# EAGLE board Dragino Pan.v2.0.1 (EAGLE 7.5.0)
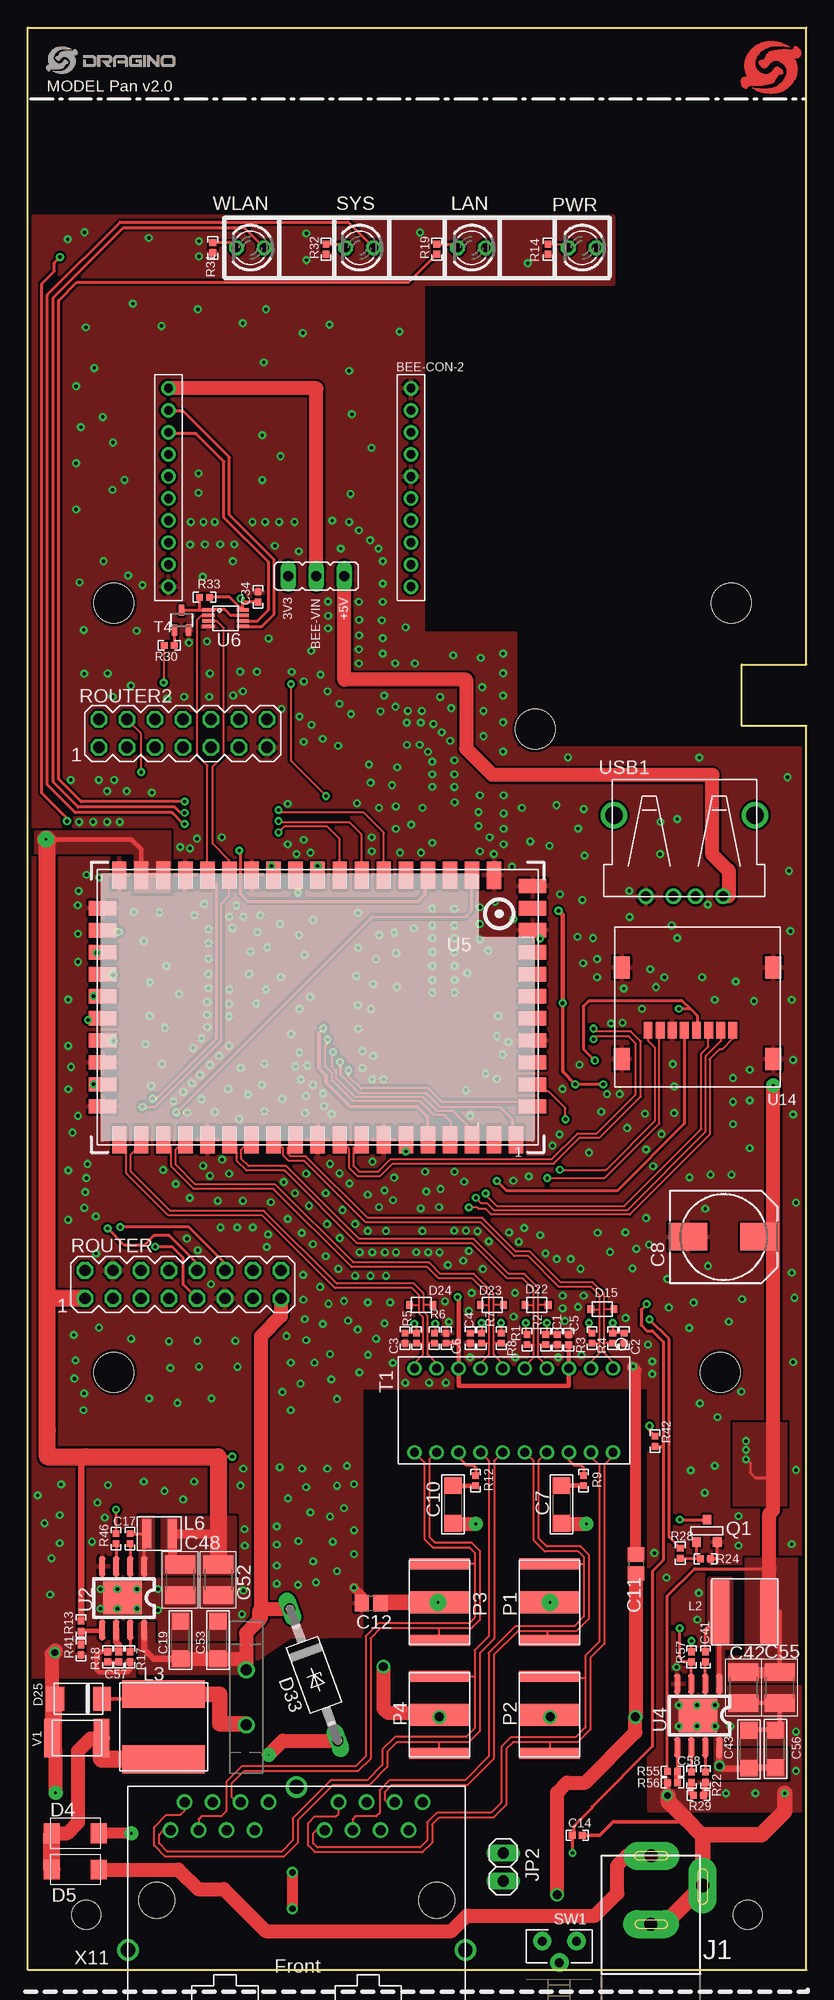
[diagram p5: board, top side]
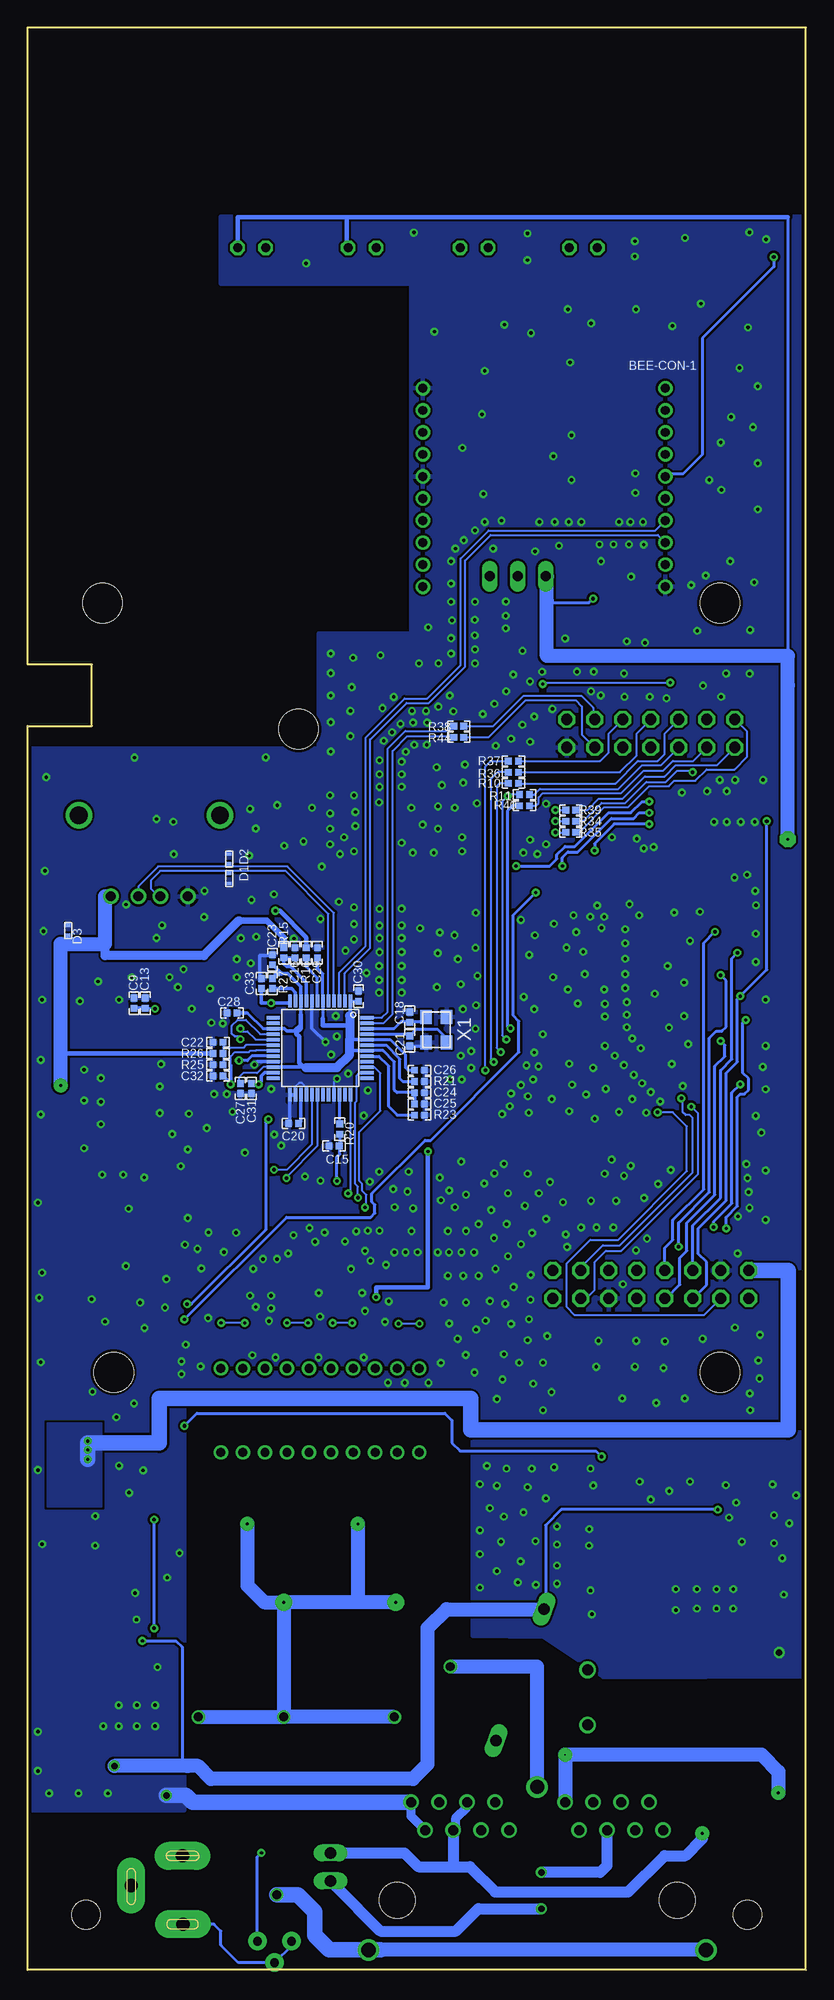
[diagram p6: board, bottom side, seen from below]

Size 70.61 x 176.23 mm. Coordinates in mm from the lower left corner, seen from the top.
Outline: 0,0 70.61,0 70.61,112.86 64.77,112.86 64.77,118.45 70.61,118.45 70.61,176.23 0,176.23 0,0
Copper layers (1*16): Top 0.035mm / dielectric 1.5mm / Bottom 0.035mm
Design rules "default *": minimum track width 8mil, minimum drill 12mil, track to track 8mil, track to pad 8mil, pad to pad 6mil, via to via 8mil, smd to smd 8mil, copper to edge 10mil, drill to drill 8mil, minimum pad ring 10mil, minimum via ring 8mil, stop-mask expansion 1mil, vias tented up to drill 30mil, thermal gap 10mil
Net classes: 0 default: clearance 0.205 mm; 2 gnd: width 0.305 mm, drill 0.33 mm, clearance 0.254 mm; 3 usbvcc: width 0.254 mm, drill 0.61 mm, clearance 0.254 mm; 5 usbtrace: width 0.254 mm, clearance 0.152 mm; 6 usbtrace-4layer: width 0.191 mm, clearance 0.203 mm
Holes 3.6 mm at 62.81,54.22 7.81,54.22 63.81,124 7.81,124 46.03,112.57
Holes 2.6 mm at 65.31,5 5.31,5
tKeepout: area 4.8,53 to 10.8,59; area 59.8,53 to 65.8,59; area 60.8,121 to 66.8,127; area 4.8,121 to 10.8,127

## Footprints (pad centres in the part's own frame; a part is rotated, then mirrored left to right if it is on the bottom)
10P-2.0MM = drill 0.8 pad 1.27: 1 0,9; 2 0,7; 3 0,5; 4 0,3; 5 0,1; 6 0,-1; 7 0,-3; 8 0,-5; 9 0,-7; 10 0,-9
JP2 = drill 0.914 long: 1 -2.54,0; 2 0,0; 3 2.54,0
C0402 = smd 0.61 x 0.61: 1 -0.457,0; 2 0.457,0
C1206 = smd 1.52 x 1.6: 1 -1.71,0; 2 1.71,0
140CLH-0810 = smd 3.5 x 2.5: + 3.25,0; - -3.25,0
C0805 = smd 1.3 x 1.5: 1 -0.85,0; 2 0.85,0
C1210 = smd 1.6 x 2.7: 1 -1.4,0; 2 1.4,0
SOD−923 = smd 0.3 x 0.4: P$1 -0.45,0; P$2 0.45,0
DO214AC = smd 1.45 x 1.8: A 2.13,0; C -2.13,0
SOD−323 = smd 0.6 x 0.7: P$1 -1.05,0; P$2 1.05,0
DO-214AA = smd 1.62 x 2.18: A 2.11,0; C -2.11,0
F126Z12 = drill 1.016 long: A 6.35,0; C -6.35,0
GR72-135 = drill 1: P$1 -2.5,0; P$2 2.5,0
POWER_JACK_SLOT = drill 1.2 pad 2.54 long: GND@1 0,0; GND@2 4.7,3.5; PWR 0.04,6.2
1X02 = drill 1.016 long: 1 -1.27,0; 2 1.27,0
SWPA6028S = smd 5.7 x 1.7: P$1 0,2.25; P$2 0,-2.25
LVS808040 = smd 2.5 x 7.5: P$1 -2.95,0; P$2 2.95,0
SWPA3010S = smd 0.8 x 2.7: P$1 -1.15,0; P$2 1.15,0
LED3MM = drill 0.813 octagon: A -1.27,0; K 1.27,0
GDT-LT-B3D090L = smd 1 x 5.5: 1 -3.48,0; 3 3.48,0 | smd 2 x 5.5: 2 0,0
SOT-23 = smd 0.787 x 0.889: 1 0,-1.016; 2 -0.95,1.016; 3 0.95,1.016
R0402 = smd 0.61 x 0.61: 1 -0.457,0; 2 0.457,0
MA08-2 = drill 1.016 octagon: 1 -8.89,-1.27; 2 -8.89,1.27; 3 -6.35,-1.27; 4 -6.35,1.27; 5 -3.81,-1.27; 6 -3.81,1.27; 7 -1.27,-1.27; 8 -1.27,1.27; 9 1.27,-1.27; 10 1.27,1.27; 11 3.81,-1.27; 12 3.81,1.27; 13 6.35,-1.27; 14 6.35,1.27; 15 8.89,-1.27; 16 8.89,1.27
MA07-2 = drill 1.016 octagon: 1 -7.62,-1.27; 2 -7.62,1.27; 3 -5.08,-1.27; 4 -5.08,1.27; 5 -2.54,-1.27; 6 -2.54,1.27; 7 0,-1.27; 8 0,1.27; 9 2.54,-1.27; 10 2.54,1.27; 11 5.08,-1.27; 12 5.08,1.27; 13 7.62,-1.27; 14 7.62,1.27
TS-026 = drill 0.8 pad 1.676: 1 -1.55,-0.975; 2 1.55,-0.975; 3 0,0.975
RIONET_H2038 = drill 0.8: 1 -3.81,9; 2 -3.81,7; 3 -3.81,5; 4 -3.81,3; 5 -3.81,1; 6 -3.81,-1; 7 -3.81,-3; 8 -3.81,-5; 9 -3.81,-7; 10 -3.81,-9; 11 3.81,-9; 12 3.81,-7; 13 3.81,-5; 14 3.81,-3; 15 3.81,-1; 16 3.81,1; 17 3.81,3; 18 3.81,5; 19 3.81,7; 20 3.81,9
SOT323 = smd 0.5 x 1: 1 0,0.9; 2 -0.65,-0.9; 3 0.65,-0.9
RT8250-SOP8 = smd 1.88 x 0.61: 1 -1.219,0; 2 -1.219,-1.27; 3 -1.219,-2.54; 4 -1.219,-3.81; 5 4.547,-3.81; 6 4.547,-2.54; 7 4.547,-1.27; 8 4.547,0 | smd 2.997 x 3.505: 9 1.651,-1.956
AU6350_LQFP-48 = smd 1.2 x 0.3: 1 -4.25,2.75; 2 -4.25,2.25; 3 -4.25,1.75; 4 -4.25,1.25; 5 -4.25,0.75; 6 -4.25,0.25; 7 -4.25,-0.25; 8 -4.25,-0.75; 9 -4.25,-1.25; 10 -4.25,-1.75; 11 -4.25,-2.25; 12 -4.25,-2.75; 25 4.25,-2.75; 26 4.25,-2.25; 27 4.25,-1.75; 28 4.25,-1.25; 29 4.25,-0.75; 30 4.25,-0.25; 31 4.25,0.25; 32 4.25,0.75; 33 4.25,1.25; 34 4.25,1.75; 35 4.25,2.25; 36 4.25,2.75 | smd 0.3 x 1.2: 13 -2.75,-4.25; 14 -2.25,-4.25; 15 -1.75,-4.25; 16 -1.25,-4.25; 17 -0.75,-4.25; 18 -0.25,-4.25; 19 0.25,-4.25; 20 0.75,-4.25; 21 1.25,-4.25; 22 1.75,-4.25; 23 2.25,-4.25; 24 2.75,-4.25; 37 2.75,4.25; 38 2.25,4.25; 39 1.75,4.25; 40 1.25,4.25; 41 0.75,4.25; 42 0.25,4.25; 43 -0.25,4.25; 44 -0.75,4.25; 45 -1.25,4.25; 46 -1.75,4.25; 47 -2.25,4.25; 48 -2.75,4.25
DRAGINO_HE-4025 = smd 1.3 x 2.5: 1 -18,12; 2 -16,12; 3 -14,12; 4 -12,12; 5 -10,12; 6 -8,12; 7 -6,12; 8 -4,12; 9 -2,12; 10 0,12; 11 2,12; 12 4,12; 13 6,12; 14 8,12; 15 10,12; 16 12,12; 17 14,12; 18 16,12; 19 18,12; 30 18,-12; 31 16,-12; 32 14,-12; 33 12,-12; 34 10,-12; 35 8,-12; 36 6,-12; 37 4,-12; 38 2,-12; 39 0,-12; 40 -2,-12; 41 -4,-12; 42 -6,-12; 43 -8,-12; 44 -10,-12; 45 -12,-12; 46 -14,-12; 47 -16,-12 | smd 2.5 x 1.3: 20 19.5,9; 21 19.5,7; 22 19.5,5; 23 19.5,3; 24 19.5,1; 25 19.5,-1; 26 19.5,-3; 27 19.5,-5; 28 19.5,-7; 29 19.5,-9; 48 -19.5,-11; 49 -19.5,-9; 50 -19.5,-7; 51 -19.5,-5; 52 -19.5,-3; 53 -19.5,-1; 54 -19.5,1; 55 -19.5,3; 56 -19.5,5; 57 -19.5,7; 58 -19.5,9
US8 = smd 0.3 x 1.1: 1 -0.75,-1.55; 2 -0.25,-1.55; 3 0.25,-1.55; 4 0.75,-1.55; 5 0.75,1.55; 6 0.25,1.55; 7 -0.25,1.55; 8 -0.75,1.55
RIONET_472192001_SD = smd 0.8 x 1.5: 1 3.2,-1.55; 2 2.1,-1.55; 3 1,-1.55; 4 -0.1,-1.55; 5 -1.2,-1.55; 6 -2.3,-1.55; 7 -3.4,-1.55; 8 -4.5,-1.55 | smd 1.45 x 2: G1 6.875,-4.15; G2 6.875,4.15; G3 -6.875,4.15; G4 -6.875,-4.15
USB_C42562 = drill 0.9: 1 -3.5,5.29; 2 -1,5.29; 3 1,5.29; 4 3.5,5.29 | drill 1.6: P$1 -6.4,-2.06; P$2 6.4,-2.06
BC301N-D = smd 1.4 x 3.5: P$1 -2.25,0; P$2 2.25,0
SMARTPRJ_CRYSTAL-3.2-2.5 = smd 1.3 x 1.05: 1 -1.15,-0.925; 2 1.15,-0.925; 3 1.15,0.925; 4 -1.15,0.925
EHERNET-1X2-PLASTIC1 = drill 0.9: 1-1 2.54,-7.49; 1-2 3.81,-4.95; 1-3 5.08,-7.49; 1-4 6.35,-4.95; 1-5 7.62,-7.49; 1-6 8.89,-4.95; 1-7 10.16,-7.49; 1-8 11.43,-4.95; 2-1 -11.43,-7.49; 2-2 -10.16,-4.95; 2-3 -8.89,-7.49; 2-4 -7.62,-4.95; 2-5 -6.35,-7.49; 2-6 -5.08,-4.95; 2-7 -3.81,-7.49; 2-8 -2.54,-4.95 | drill 1.3: P$1 0,-8.89; P$2 -15.3,5.9; P$3 15.3,5.9 | hole 3.25: -12.7,1.4; 12.7,1.4

## Placement (x,y rotation side)
BEE-CON-1  BEE-1  [10P-2.0MM]  12.75,134.5 0 top
BEE-CON-2  BEE-1  [10P-2.0MM]  34.75,134.5 0 top
BEE-VIN  1x3 , 2.54 弯针  [JP2]  26.16,126.45 0 top
C1  0.1uF  [C0402]  48.03,57.19 270 top
C2  0.1uF  [C0402]  54.09,57.32 270 top
C3  0.1uF  [C0402]  34.22,57.32 270 top
C4  0.1uF  [C0402]  40.13,57.32 270 top
C5  0.1uF  [C0402]  49.07,57.19 90 top
C6  0.1uF  [C0402]  37.94,57.32 90 top
C7  1000pF 2kv  [C1206]  48.42,42.23 270 top
C8  470uF 10v  [140CLH-0810]  63.12,66.5 0 top
C9  0.1uF  [C0402]  60.96,87.71 90 bottom
C10  1000pF 2kv  [C1206]  38.58,42.23 270 top
C11  0.1uF,100V  [C0805]  55.15,36.83 270 top
C12  0.1uF,100V  [C0805]  31.14,33.26 0 top
C13  1uF  [C0402]  59.94,87.71 90 bottom
C14  1pf  [C0402]  49.84,12.2 0 top
C15  10pf,NL  [C0402]  42.8,74.76 180 bottom
C16  2.2uF  [C0402]  46.35,92.29 90 bottom
C17  0.1u,50v  [C0402]  9.27,39.12 90 top
C18  18pF  [C0402]  35.94,86.44 90 bottom
C19  10uf,50v  [C1206]  13.84,29.93 90 top
C20  1uF  [C0402]  46.48,76.79 180 bottom
C21  18pF  [C0402]  35.94,84.28 270 bottom
C22  1uF  [C0402]  53.34,84.16 180 bottom
C23  4.7uF  [C0402]  48.39,91.65 90 bottom
C24  4.7uF  [C0402]  35.05,79.59 0 bottom
C25  1uF  [C0402]  35.05,78.57 0 bottom
C26  4.7uF  [C0402]  35.05,81.62 0 bottom
C27  0.1uF  [C0402]  51.31,79.97 270 bottom
C28  0.1uF  [C0402]  52.07,86.83 180 bottom
C29  0.1uF  [C0402]  44.32,92.29 90 bottom
C30  0.1uF  [C0402]  40.59,88.35 90 bottom
C31  4.7uF  [C0402]  50.29,79.97 270 bottom
C32  4.7uF  [C0402]  53.34,81.11 180 bottom
C33  0.1uF  [C0402]  49.4,89.49 90 bottom
C34  0.1u  [C0402]  20.88,124.57 90 top
C41  0.1u,50v  [C0402]  61.47,28.41 90 top
C42  22uf,10v  [C1210]  64.9,25.61 270 top
C43  10uf,50v  [C1206]  65.41,20.02 90 top
C48  22uF,10v  [C1210]  13.82,35.39 270 top
C52  22uF,10v  [C1210]  17.27,35.39 270 top
C53  10uf,50v  [C1206]  17.25,29.93 90 top
C55  22fu,10v  [C1210]  68.2,25.61 270 top
C56  10uf,50v  [C1206]  67.82,20.05 90 top
C57  2.7nf  [C0402]  8.25,28.41 90 top
C58  2.7nf  [C0402]  60.2,17.48 90 top
D1  ESD7951ST5G  [SOD−923]  52.32,99.02 270 bottom
D2  ESD7951ST5G  [SOD−923]  52.32,100.8 90 bottom
D3  ESD7951ST5G  [SOD−923]  66.93,94.32 90 bottom
D4  STPS1L30  [DO214AC]  4.32,12.4 0 top
D5  STPS1L30  [DO214AC]  4.32,9.1 0 top
D15  BS05C  [SOD−323]  52.11,59.95 0 top
D22  BS05C  [SOD−323]  46.15,60.33 0 top
D23  BS05C  [SOD−323]  42.11,60.33 0 top
D24  BS05C  [SOD−323]  35.69,60.33 0 top
D25  SMBJ43A  [DO-214AA]  4.61,24.59 180 top
D33  1N4001  [F126Z12]  25.94,26.77 290 top
F2  GRD-GR72-135 1.35A  [GR72-135]  19.81,24.72 90 top
J1  POWER_JACKSLT  [POWER_JACK_SLOT]  56.52,4.15 0 top
JP2  [1X02]  43.13,9.33 270 top
L2  6.8uH / SWPA6045S6R8MT  [SWPA6028S]  65.02,32.47 90 top
L3  100uH, 1.4A, LVS808040-101  [LVS808040]  12.32,22.06 90 top
L6  4.7uH /SWPA3015S4R7MT  [SWPA3010S]  11.94,39.58 0 top
LAN  [LED3MM]  40.26,156.25 180 top
P1  3R420L  [GDT-LT-B3D090L]  47.31,33.36 270 top
P2  3R420L  [GDT-LT-B3D090L]  47.31,23.14 270 top
P3  3R420L  [GDT-LT-B3D090L]  37.34,33.36 270 top
P4  3R420L  [GDT-LT-B3D090L]  37.34,23.14 270 top
PWR  [LED3MM]  50.29,156.25 180 top
Q1  BSS138-7-F  [SOT-23]  61.59,39.84 180 top
R1  49.9  [R0402]  45.29,57.19 270 top
R2  49.9  [R0402]  46.99,57.19 270 top
R3  49.9  [R0402]  51.18,57.32 270 top
R4  49.9  [R0402]  53.05,57.32 270 top
R5  49.9  [R0402]  35.26,57.32 270 top
R6  49.9  [R0402]  36.88,57.32 270 top
R7  49.9  [R0402]  41.14,57.32 270 top
R8  49.9  [R0402]  42.95,57.32 270 top
R9  75  [R0402]  50.41,44.4 90 top
R10  0R  [R0402]  26.54,107.65 180 bottom
R11  0R  [R0402]  25.53,106.64 0 bottom
R12  75  [R0402]  40.61,44.39 90 top
R13  75K 1%  [R0402]  4.83,31.2 90 top
R14  330  [R0402]  47.18,156.13 90 top
R15  0R  [R0402]  47.37,92.29 270 bottom
R16  0R  [R0402]  45.34,92.29 270 bottom
R17  180K  [R0402]  9.27,28.41 270 top
R18  16K 1%  [R0402]  7.24,28.41 270 top
R19  330  [R0402]  37.08,156.13 90 top
R20  0R  [R0402]  42.29,76.28 270 bottom
R21  680  [R0402]  35.05,80.6 180 bottom
R22  180K  [R0402]  61.47,17.48 270 top
R23  330  [R0402]  35.05,77.55 0 bottom
R24  47K,NL  [R0402]  61.47,37.3 180 top
R25  470K  [R0402]  53.34,82.13 180 bottom
R26  47K  [R0402]  53.34,83.14 180 bottom
R27  0R  [R0402]  48.39,89.49 270 bottom
R28  4.7k  [R0402]  59.18,37.8 270 top
R29  24K  [R0402]  60.83,15.83 0 top
R30  4.7K  [R0402]  12.83,120.18 180 top
R31  330  [R0402]  16.76,156.25 90 top
R32  330  [R0402]  27.05,156.13 90 top
R33  100K  [R0402]  16.03,124.54 0 top
R34  0R  [R0402]  21.34,104.22 180 bottom
R35  0R  [R0402]  21.34,103.21 180 bottom
R36  0R  [R0402]  26.54,108.67 180 bottom
R37  0R  [R0402]  26.54,109.69 180 bottom
R38  0R,NL  [R0402]  31.5,112.86 180 bottom
R39  0R  [R0402]  21.34,105.24 0 bottom
R40  0R  [R0402]  25.53,105.62 0 bottom
R41  24K 1%  [R0402]  4.83,29.04 90 top
R42  10K  [R0402]  56.9,47.96 270 top
R44  0R,NL  [R0402]  31.5,111.84 0 bottom
R46  100K  [R0402]  8,39.12 270 top
R55  53.6K 1%  [R0402]  58.47,18.02 180 top
R56  10K 1%  [R0402]  58.47,16.97 0 top
R57  100K  [R0402]  60.2,28.41 90 top
ROUTER  [MA08-2]  14.07,62.19 0 top
ROUTER2  [MA07-2]  14.07,112.19 0 top
SW1  TS-026  [TS-026]  48.21,1.62 180 top
SYS  [LED3MM]  30.1,156.25 180 top
T1  RJ45_TRANSFORMER_HST2038DR  [RIONET_H2038]  44.08,50.76 270 top
T4  2SC4081/SC70  [SOT323]  13.94,122.46 0 top
U2  RT7272  [RT8250-SOP8]  10.54,35.39 270 top
U3  AU6353  [AU6350_LQFP-48]  44.07,83.65 270 bottom
U4  RT7272  [RT8250-SOP8]  62.74,24.72 270 top
U5  DRAGINO_HE-4025  [DRAGINO_HE-4025]  26.29,87.33 180 top
U6  NC7WZ125  [US8]  17.93,122.64 270 top
U14  [RIONET_472192001_SD]  60.76,86.8 0 top
U$3  LOGO-NEW  [LOGO-SILK-NEW]  1.67,172.05 0 top
U$7  [DRGAINO_LOGO_STOP]  64.51,170.07 0 top
USB1  USB_C42562  [USB_C42562]  59.56,102.7 180 top
V1  BC301N-D  [BC301N-D]  4.44,21.04 0 top
WLAN  [LED3MM]  20.19,156.25 180 top
X1  12Mhz  [SMARTPRJ_CRYSTAL-3.2-2.5]  33.53,85.3 270 bottom
X11  EHERNET-1X2-PLASTIC  [EHERNET-1X2-PLASTIC1]  24.38,7.72 180 top

## Tracks (layer width: path | path; a pad name or v marks a point on that pad's centre or on a via)
2.0V_CTL  (via drill 0.3)
  Top 0.406: T1.3 49.07,52.99 39.08,52.99 T1.8 39.08,56.86 | T1.3 | C6.1 39.08,56.86 | T1.3 C5.1 | U5.6 v34.29,74.25 | v38.99,61.04 39.08,61.04 39.08,56.86
  Bottom 0.406: v34.29,74.25 34.29,61.93 38.99,61.93 v38.99,61.04
+3V3  (via drill 0.25 pad 1.42, 0.33)
  Top 0.203: 2.29,50.25 2.29,48.98 1.78,48.98
  Top 0.254: 20.95,124.04 C34.1 19.61,124.11 v19.3,124.42 19.48,124.24 U6.8 18.33,124.54 R33.2 | R42.1 56.39,48.93 v56.39,49.36 | v18.54,46.57 17.27,46.57 | U5.31 10.29,99.27
  Top 0.406: 10.29,98.89 10.29,99.27 10.29,101.68 9.4,102.57 v1.65,102.57 | U5.31 U5.32
  Top 0.61: R13.2 4.83,46.16 5.23,46.57
  Top 0.813: C48.1 13.74,36.71 13.28,36.71 13.09,36.91 L6.P$2 17.27,39.58
  Top 1.524: 1.78,60.92 1.78,48.98 1.78,46.57 5.23,46.57 17.27,46.57 17.27,39.58 C52.1 | ROUTER.1 1.78,60.92 | 1.78,60.92 1.78,102.45
  Top 1.676: 1.78,102.45 v1.65,102.57
  Bottom 0.254: 1.65,159.05 1.65,119.21 | 23.49,124.16 23.37,124.04 19.68,124.04 v19.3,124.42 | v56.39,49.36 55.24,50.5 32.77,50.5 32.13,49.87 32.13,47.84 31.37,47.07 19.05,47.07 v18.54,46.57
  Bottom 0.406: PWR.A 51.56,159.05 41.66,159.05 | LAN.A 41.66,156.25 41.66,159.05 | 1.65,159.05 41.66,159.05 | 1.65,116.54 1.65,107.91 1.78,107.78 | 22.86,119.08 22.99,119.21
  Bottom 1.27: v1.65,102.57 1.65,116.54 1.65,119.21 22.99,119.21 23.49,119.21 23.49,124.16 23.49,126.45 BEE-VIN.1
  pour Top (isolate 0.305, no thermals): 18.8,35.9 12.19,35.9 12.19,41.1 18.8,41.1
  pour Top (no thermals): 0.63,103.34 12.95,103.34 12.95,97.75 9.65,97.75 9.65,101.3 0.63,101.3
+5V  (via drill 0.25 pad 1.27, 0.3)
  Top 0.203: 65.99,44.64 65.58,45.04 65.58,45.96 65.36,46.17 65.29,46.17 v65.15,46.31 | 67.56,41.66 67.61,41.72
  Top 0.254: R55.2 58.01,33.94 60.48,36.41 67.27,36.41 | 65.99,44.64 67.61,44.64 67.61,44.53
  Top 0.406: L2.P$2 68.2,32.47 C55.1
  Top 1.016: C42.1 C55.1
  Top 1.27: 67.61,41.72 67.61,44.53 67.61,66.23 | 67.61,66.23 v67.61,80.25 | 67.56,41.66 67.27,41.37 67.27,36.41 L2.P$2 | C8.+ 67.34,66.5 67.61,66.23 | USB1.1 63.57,97.41 63.57,99.78 63.5,99.78 62.1,101.18 62.1,108.41 42.16,108.41 39.75,110.83 39.75,117.05 28.7,117.05 BEE-VIN.3
  Bottom 0.305: D3.P$1 66.93,93.1
  Bottom 0.406: R26.2 67.61,83.14
  Bottom 0.61: R15.1 47.37,93.68 48.89,95.21 51.44,95.21
  Bottom 0.813: 51.44,95.21 54.61,92.03 63.57,92.03 63.57,93.81
  Bottom 1.016: v65.15,47.18 v65.15,47.99
  Bottom 1.27: v67.61,80.25 67.61,83.14 67.61,93.1 66.93,93.1 63.57,93.1 63.57,93.81 63.57,97.41 USB1.1
  Bottom 1.422: ROUTER.2 1.63,63.46 1.63,48.98 30.43,48.98 30.43,51.85 58.65,51.85 58.65,47.81 65.15,47.81 v65.15,47.18 v65.15,46.31
  pour Bottom (no thermals): 63.88,49.61 63.88,41.99 68.83,41.99 68.83,49.61
  pour Top (no thermals): 64.01,49.61 64.01,42.12 68.83,42.12 68.83,49.61
  pour Top (isolate 0.254, no thermals): 69.72,26.12 63.63,26.12 63.63,28.41 65.15,28.41 65.15,37.3 69.72,37.3
/BEE_OE
  Top 0.254: 13.93,123.35 T4.1 15.49,123.36 | 15.49,123.36 16.35,123.36 U6.1 16.39,123.4 17.91,123.4 18.42,122.89 U6.7 | R33.1 15.57,123.44 15.49,123.36
/RESET_HE  (via drill 0.3)
  Top 0.203: U5.46 40.29,96.13 39.75,95.59 31.24,95.59 v13.46,77.81
  Bottom 0.203: ROUTER.3 7.74,60.92 9.27,59.39 20.95,59.39 21.72,60.16 21.72,64.09 19.56,66.25 17.02,66.25 10.79,72.47 10.79,76.54 12.06,77.81 v13.46,77.81
BEE-RXD
  Top 0.254: U6.6 20.83,122.39 21.84,123.4 21.84,127.72 17.78,131.78 17.78,136.86 15.24,139.4 12.85,139.4 BEE-CON-1.3
BEE-TXD
  Top 0.254: U6.5 21.22,121.89 22.35,123.02 22.35,127.97 18.29,132.04 18.29,137.24 14.1,141.44 12.82,141.44 BEE-CON-1.2
BEE-VIN
  Top 1.27: BEE-VIN.2 26.16,143.5 BEE-CON-1.1
CHIP_RESETN
  Bottom 0.203: U3.18 50.8,83.9 51.05,83.65 52.88,83.65 | C22.1 52.88,83.65 | 52.88,83.65 R26.1 R25.1
CPWR_V33  (via drill 0.3, 0.33)
  Top 0.254: 60.07,87.21 59.31,87.97 50.93,87.97 50.42,87.46 50.42,83.52 v51.44,82.51 | 60.07,87.21 60.71,86.57 60.71,85.3 U14.4 | v59.05,87.21 60.07,87.21
  Bottom 0.203: C13.1 59.05,87.26 v59.05,87.21
  Bottom 0.254: U3.20 50.28,82.9 50.67,82.51 v51.44,82.51
  Bottom 0.305: C13.1 C9.1
DC-VIN
  Top 0.406: J1.PWR 56.39,10.35 56.39,10.37
  Top 1.27: D5.A 13.66,9.1 15.44,7.32 17.78,7.32 21.59,3.51 38.43,3.51 39.83,4.91 51.44,4.91 53.47,6.94 53.47,9.48 54.36,10.37 56.39,10.37 57.29,10.37
GND  (via drill 0.13 pad 1.27, 0.25 pad 1.27, 0.3, 0.58, 0.6)
  Top 0.203: 2.16,19.9 2.2,19.9 V1.P$1
  Top 0.254: R24.1 62.33,37.3 62.53,37.5 62.53,38.81 Q1.2
  Top 0.305: D25.A 2.86,24.59 2.2,25.25 | C14.2 51.87,12.2 53.09,13.42 59.56,13.42 59.75,13.61
  Top 0.406: V1.P$1 2.29,20.95 | R17.2 9.27,27.26 9.02,27.01 6.48,27.01 6.22,27.26 6.22,28.53 6.55,28.86 R18.1 | C42.2 C55.2 68.2,22.14 C56.2 65.43,21.76 C43.2 | U5.50 46.46,94.33 v46.46,93.58
  Top 0.61: R22.2 61.47,16.01 R29.2 | R56.1 v58.01,15.83
  Top 0.813: v29.58,34.68 30.29,33.97 C12.1
  Top 1.016: C11.1 55.15,54.41 54.86,54.69
  Top 1.27: 2.2,28.61 2.16,28.61 2.16,19.9 2.5,19.9 | 2.5,19.9 D25.A | 2.5,19.9 2.5,16.07 v2.52,16.06 | 58.09,15.76 v58.01,15.83 | v21.84,19.52 23.13,20.8 D33.A
  Top 1.422: 2.2,28.61 2.5,28.91 | 58.09,15.76 58.09,15.27 59.75,13.61 61.09,12.28 | 61.09,12.28 61.21,12.15 J1.GND@2 57.71,4.15 J1.GND@1 | v68.66,16.02 68.66,14.39 66.55,12.28 61.09,12.28
  Bottom 0.203: C15.2 43.31,74.76 | v42.54,80.86 42.82,80.58 U3.33 | U3.28 45.32,80.07 45.72,80.47 45.97,80.47 46.35,80.09 46.35,79.44 U3.26
  Bottom 0.254: C21.2 34.78,83.83 X1.2 | SW1.2 46.66,2.2 SW1.3 51.49,0.65 53.09,2.24 53.09,3.51 53.72,4.15 J1.GND@1
  Bottom 0.305: 46.35,79.44 46.39,79.4 U3.25 46.82,76.91 C20.2 | U3.8 44.82,85.43 v43.58,84.19 | C23.2 48.46,92.03 49.53,92.03 49.53,89.95 C33.2 | U3.21 49.76,82.4 v50.04,82.13
  Bottom 0.813: X11.2-2 35.81,13.94 X11.2-1
  Bottom 1.27: X11.1-1 v21.84,19.52 4.03,19.52 2.5,17.99 2.5,16.07 v2.52,16.06 | X11.2-1
  Bottom 1.422: X11.2-1 55.63,15.2 56.26,15.83 v58.01,15.83
  other vias: 2.44,28.79 12.8,57.03 15.39,57.08 15.52,54.72 12.93,54.62 5.11,52.31 5.05,50.78 4.22,53.65 4.32,55.3 4.17,57.62 6.17,68.36 5.41,73.11 5.13,69.15 5.21,70.57 5.31,71.84 29.92,58.1 26.75,58.61 36.04,72.42 52.02,77.86 32.36,70.72 32.26,80.81 16.51,72.04 44.04,95.36 55.98,77.68 5.34,99.35 4.53,96.59 33.35,114.61 25.27,155.13 15.52,156.85 62.56,50.15 60.96,51.39 40.79,67.01 51.69,66.89 39.75,67.06 30.1,65.11 16.66,51.85 11,51.85 0.9,43.05 12.4,43.45 60.4,60.55 64.8,60.85 60,58.25 14.09,79.64 16.97,77.83 18.17,79.93 19.17,77.23 15.75,79.01 42.66,86.55 42.57,84.7 9.62,96.01 4.6,97.9 9.86,121.5 5.07,121.58 5.11,117.61 27.23,124.15 21.85,120.8 23.01,114.41 25.04,116.9 35.57,157.63 25.27,157.55 15.53,155.47 30.86,55.79 40.12,55.57 38.19,58.78 33.12,55.07 35.23,65.11 41.81,66.1 44.22,55.57 48.12,55.57 48.72,58.87 50.22,55.77 46.48,66.66 53.68,79.46 58.02,62.68 15.42,65.29 31.99,114.19 56.83,37.83 30.05,122.49 54.56,97.9 56.46,90.79 48.5,79.93 40.12,77.51 39.74,79.8 54.92,54.76 61.4,43.29 60.13,45.32 31.23,80.78 13.72,88.56 16.52,82.09 16.39,90.35 22.87,94.92 11.94,95.94 31.88,93.89 29.97,92.74 16.51,117.62 7.24,117.62 57.94,35.59 58.83,27.47 60.86,34.2 60.73,31.78 7.26,43.98 24.54,38.9 63.33,16.02 65.99,16.02 69.68,18.05 69.68,21.61 64.47,38.5 64.47,41.16 69.29,38.62 69.68,45.35 62.31,45.74 64.72,52.47 69.55,60.98 69.42,55.13 69.68,69.61 58.63,77.74 58.63,80.15 56.09,74.44 44.53,66.06 57.48,75.83 65.48,78.88 69.42,77.61 62.31,88.03 58.5,82.18 65.87,87.9 65.48,81.68 69.42,82.57 69.29,88.03 69.17,94.25 68.91,108.22 69.04,99.71 60.91,110 47.96,105.68 57.36,101.23 61.67,96.66 50.5,101.11 47.32,102 42.37,96.92 33.23,94.12 38.69,92.34 54.05,89.04 51.64,91.71 52.91,85.87 31.32,82.95 24.75,80.78 29.58,44.08 29.58,39.89 29.58,37.73 24.5,34.93 19.42,32.27 19.67,38.49 19.29,43.95 6.97,41.03 14.09,42.68 1.51,40.52 2.02,34.05 13.58,51.44 18.82,57.08 15.9,72.96 31.27,73.34 10.67,84 11.06,89.59 16.39,89.08 18.29,88.95 21.72,92.76 33.41,92.25 29.85,105.84 18.93,96.57 18.55,94.54 11.06,86.54 6.48,99.11 25.03,102.54 33.03,107.49 29.32,113.94 38.72,105.94 43.16,106.57 44.81,105.43 49,110 57.39,104.16 32.11,122.45 30.05,121.09 28.27,114.87 7.7,115.5 9.35,116.52 16.46,115.5 19.25,117.79 18.62,115.63 4.69,125.89 10.4,125.64 14.72,129.32 15.87,126.4 4.38,136.7 4.38,132.51 4.38,143.69 18.6,127.81 3.61,157.02 5.14,157.66 10.98,157.15 30.03,124.13 43.11,117.65 38.71,72.42 34.4,111.15 35.54,111.15 36.3,110.51 36.68,109.62 36.68,108.48 36.68,107.34 36.68,102.26 29.95,95.91 36.68,96.29 36.68,94.76 36.68,93.62 36.68,92.35 36.68,91.08 36.68,89.81 36.68,88.67 38.72,88.67 38.72,89.81 38.72,91.08 38.69,93.61 38.69,94.76 38.69,96.28 38.69,107.33 38.69,108.47 38.69,109.74 38.31,111.52 37.54,112.28 36.78,113.05 35.64,113.17 34.37,113.17 27.24,121.71 27.24,122.86 24.57,128.7 32.19,124.13 32.19,125.78 28.38,128.95 35.75,114.22 32.32,115.62 43.11,119.43 32.19,120.83 32.19,119.43 41.33,114.22 43.11,115.62 41.33,111.94 43.11,113.21 43.11,110.54 41,106.57 40.88,105.05 43.16,104.92 40.88,103.78 43.16,103.53 43.16,102.13 41,101.49 41,96.41 41,94.89 41,93.49 41.76,92.48 39.86,90.45 20.83,94.16 16.01,96.7 15.12,95.68 16.39,91.74 18.29,95.55 16.39,94.41 16.39,93.14 19.56,95.55 21.09,95.68 16.26,87.81 16.26,86.66 16.26,85.52 15.63,81.2 14.87,80.44 11.18,80.19 14.99,83.62 15.75,84.51 14.48,77.77 13.21,78.79 54.36,76.38 38.68,67.06 45.03,67.32 33.22,71.89 65.48,74.56 28.27,72.27 35.64,69.1 36.14,70.62 26.87,78.37 39.57,71.51 52.54,79.46 53.94,85.93 55.72,87.2 27.41,73.13 54.2,66.91 29.18,71.36 30.84,70.34 31.85,69.2 33.12,69.83 27.03,64.75 43.66,66.91 46.96,65.01 47.98,64.5 49.25,64.5 50.14,63.61 52.81,65.13 61.44,69.07 61.7,63.86 61.17,90.06 51.64,90.06 51.26,93.61 23.07,79.01 26.75,79.52 25.1,92.09 25.61,88.28 31.32,89.42 23.57,105.81 9.1,126.51 45.35,154.84 30.03,119.81 30.03,118.54 33.33,118.54 35.11,118.54 41.08,119.05 41.21,116.38 34.48,114.22 38.41,114.48 37.4,115.49 20.78,117.79 19.51,116.01 25.73,112.96 36.4,53.27 37.92,53.27 34.24,53.27 6.59,34.55 8.12,34.55 9.9,34.55 11.8,34.55 6.59,32.78 8.12,32.78 9.9,32.78 11.8,32.65 19.55,34.43 2.15,37.35 59.04,24.01 60.7,24.01 62.35,24.01 59.04,22.11 60.7,22.11 62.35,22.11 63.74,22.11 8.33,104.16 7.19,104.16 5.92,104.16 4.65,104.16 3.89,107.97 6.43,107.97 7.83,107.97 23.57,102.12 17.61,102.76 25.86,95.27 31.19,102.76 31.19,101.49 17.35,82.95 18.24,87.65 18.24,83.84 22.94,90.06 18.24,86.5 25.35,82.06 25.23,79.26 25.86,80.28 29.92,87.52 31.58,91.71 33.48,89.17 35,94.5 29.8,90.19 24.59,93.87 30.94,109.36 26.75,111.69 28.14,111.06 16.26,120.54 16.06,129.33 17.46,129.33 18.73,129.33 22.41,129.21 14.79,131.37 15.93,131.37 16.95,131.37 20.38,131.37 21.52,131.37 22.79,131.37 24.19,131.37 27.62,131.49 29.14,131.37 30.03,130.6 31.05,129.72 31.81,128.95 32.19,127.81 5.27,149.02 6.03,145.34 12.12,149.15 19.49,149.4 27.36,149.27 29.14,145.08 33.71,148.64 21.39,145.84 21.27,139.24 21.27,135.18 22.92,137.34 31.17,138.1 29.27,133.91 29.4,141.15 7.68,134.29 6.79,140.89 24.95,148.51 15.43,150.67 23.93,117.78 25.71,119.68 56.72,72.91 14.61,120.42 41.52,81.32 31.24,65.11 32.38,65.11 33.4,65.11 36.32,65.11 37.34,65.11 38.1,63.97 39.5,64.35 40,65.23 41.27,63.58 44.2,61.42 40.26,61.42 37.85,60.66 40,59.77 44.07,59.27 48.51,61.17 49.91,60.16 50.42,61.17 48.51,60.03 54.23,59.14 56.64,55.2 56.26,56.73 56.64,54.06 17.48,67.37 20.4,67.37 19,67.37 21.67,65.59 25.86,65.84 24.84,66.86 23.57,68.13 22.05,69.65 19.51,69.78 17.22,69.78 14.68,70.04 13.41,71.31 12.27,72.58 14.43,66.35 21.79,66.73 24.97,63.05 28.17,63.61 29.69,62.97 31.09,62.97 32.49,62.97 24.99,60.82 27.28,60.43 26.52,61.96 23.47,57.51 25.12,59.04 28.68,60.69 30.84,60.56 32.87,60.56 32.36,58.66 29.06,58.91 26.01,55.1 23.85,55.1 27.41,55.86 25.25,57.13 31.6,57.26 30.07,54.21 28.04,51.8 27.53,53.58 23.09,52.43 24.74,53.2 23.85,50.78 19.02,54.72 25.63,41.51 22.58,35.03 22.58,36.69 22.58,38.59 22.58,40.24 19.66,39.99 26.14,35.16 28.04,36.18 25.88,37.07 27.66,38.84 27.41,41.13 23.6,42.78 25.25,43.8 28.04,43.92 28.68,41.89 15.09,44.31 10.52,44.31 3.02,44.05 2.9,41.26 6.32,42.4 5.82,38.84 2.9,38.72 3.66,68.05 6.2,65.01 6.45,58.28 9.37,57.26 16.61,62.21 17.63,73.52 18.26,72.25 24.23,70.47 23.22,71.48 25.5,69.32 27.15,67.67 28.3,66.4 30.84,67.04 32.49,67.04 28.55,68.94 25.25,72.25 27.03,70.47 29.69,67.67 35.79,67.04 37.31,69.2 37.44,70.85 44.04,71.61 45.44,71.99 50.9,74.15 47.6,74.79 48.23,75.8 43.07,83.05 49.86,93.74 50.37,91.33 56.98,89.17 57.74,90.06 64.21,89.68 61.93,72.15 63.96,76.72 63.96,78.76 63.96,80.91 55.2,65.42 56.09,68.21 56.34,65.8 60.02,71.9 63.83,72.15 63.58,58.82 69.29,63.26 42.27,101.24 41.89,102.76 43.92,100.1 45.57,102.38 33.76,101.37 34.78,103.91 33.38,105.56 33.38,103.53 31.86,105.43 35.8,105.43 35.67,101.37 24.37,101.24 25.64,101.37 13.82,101.88 14.71,101.75 15.35,102.64 12.43,85.49 12.55,91.08 10.52,93.37 20.71,87.68 20.2,92.38 20.07,90.35 21.6,88.95 19.95,79.43 21.47,82.22 23.88,84.89 24.64,87.17 24.26,81.97 21.22,80.31 19.31,81.84 21.47,77.9 27.57,77.65 25.15,77.77 30.36,81.84 30.36,83.36 31.12,87.17 29.98,85.39 24.64,83.24 48.27,97.59 50.3,97.08 49.92,103.56 50.43,105.33 25.03,111.43 24.64,113.72 26.55,117.53 27.18,116 21.6,150.67 9.53,151.18 6.86,127.81 8.77,135.18 3.66,88.03 3.66,83.84 4.55,94 4.55,91.46 3.66,79.9 3.92,81.94 4.05,75.97 4.55,77.49 3.66,72.54 12.17,82.19 54.59,95.53 58.4,94.76 58.91,93.62 58.91,104.42 38.59,119.27 34.27,121.81 33.51,109.11 31.1,107.72 15.48,134.01 15.48,135.78 7.73,138.58 4.81,139.98 54.85,63.65 58.15,60.09 7.19,106.95 8.97,106.95 11.26,106.82 12.65,115.37 14.17,115.5 19.55,45.48 22.85,45.6 24.88,45.48 27.17,45.48 28.95,45.73